# EasyEDA Pro project 库洛密nfc.eprj

# Schematic Schematic1
Board Name: Board1; Create Date: 2025-10-13; Page Name: P1; Project Name: 校园卡PCB; Schematic Name: Schematic1; Update Date: 2025-10-13; Company: 嘉立创EDA; Page Size: A4; Version: V1.0
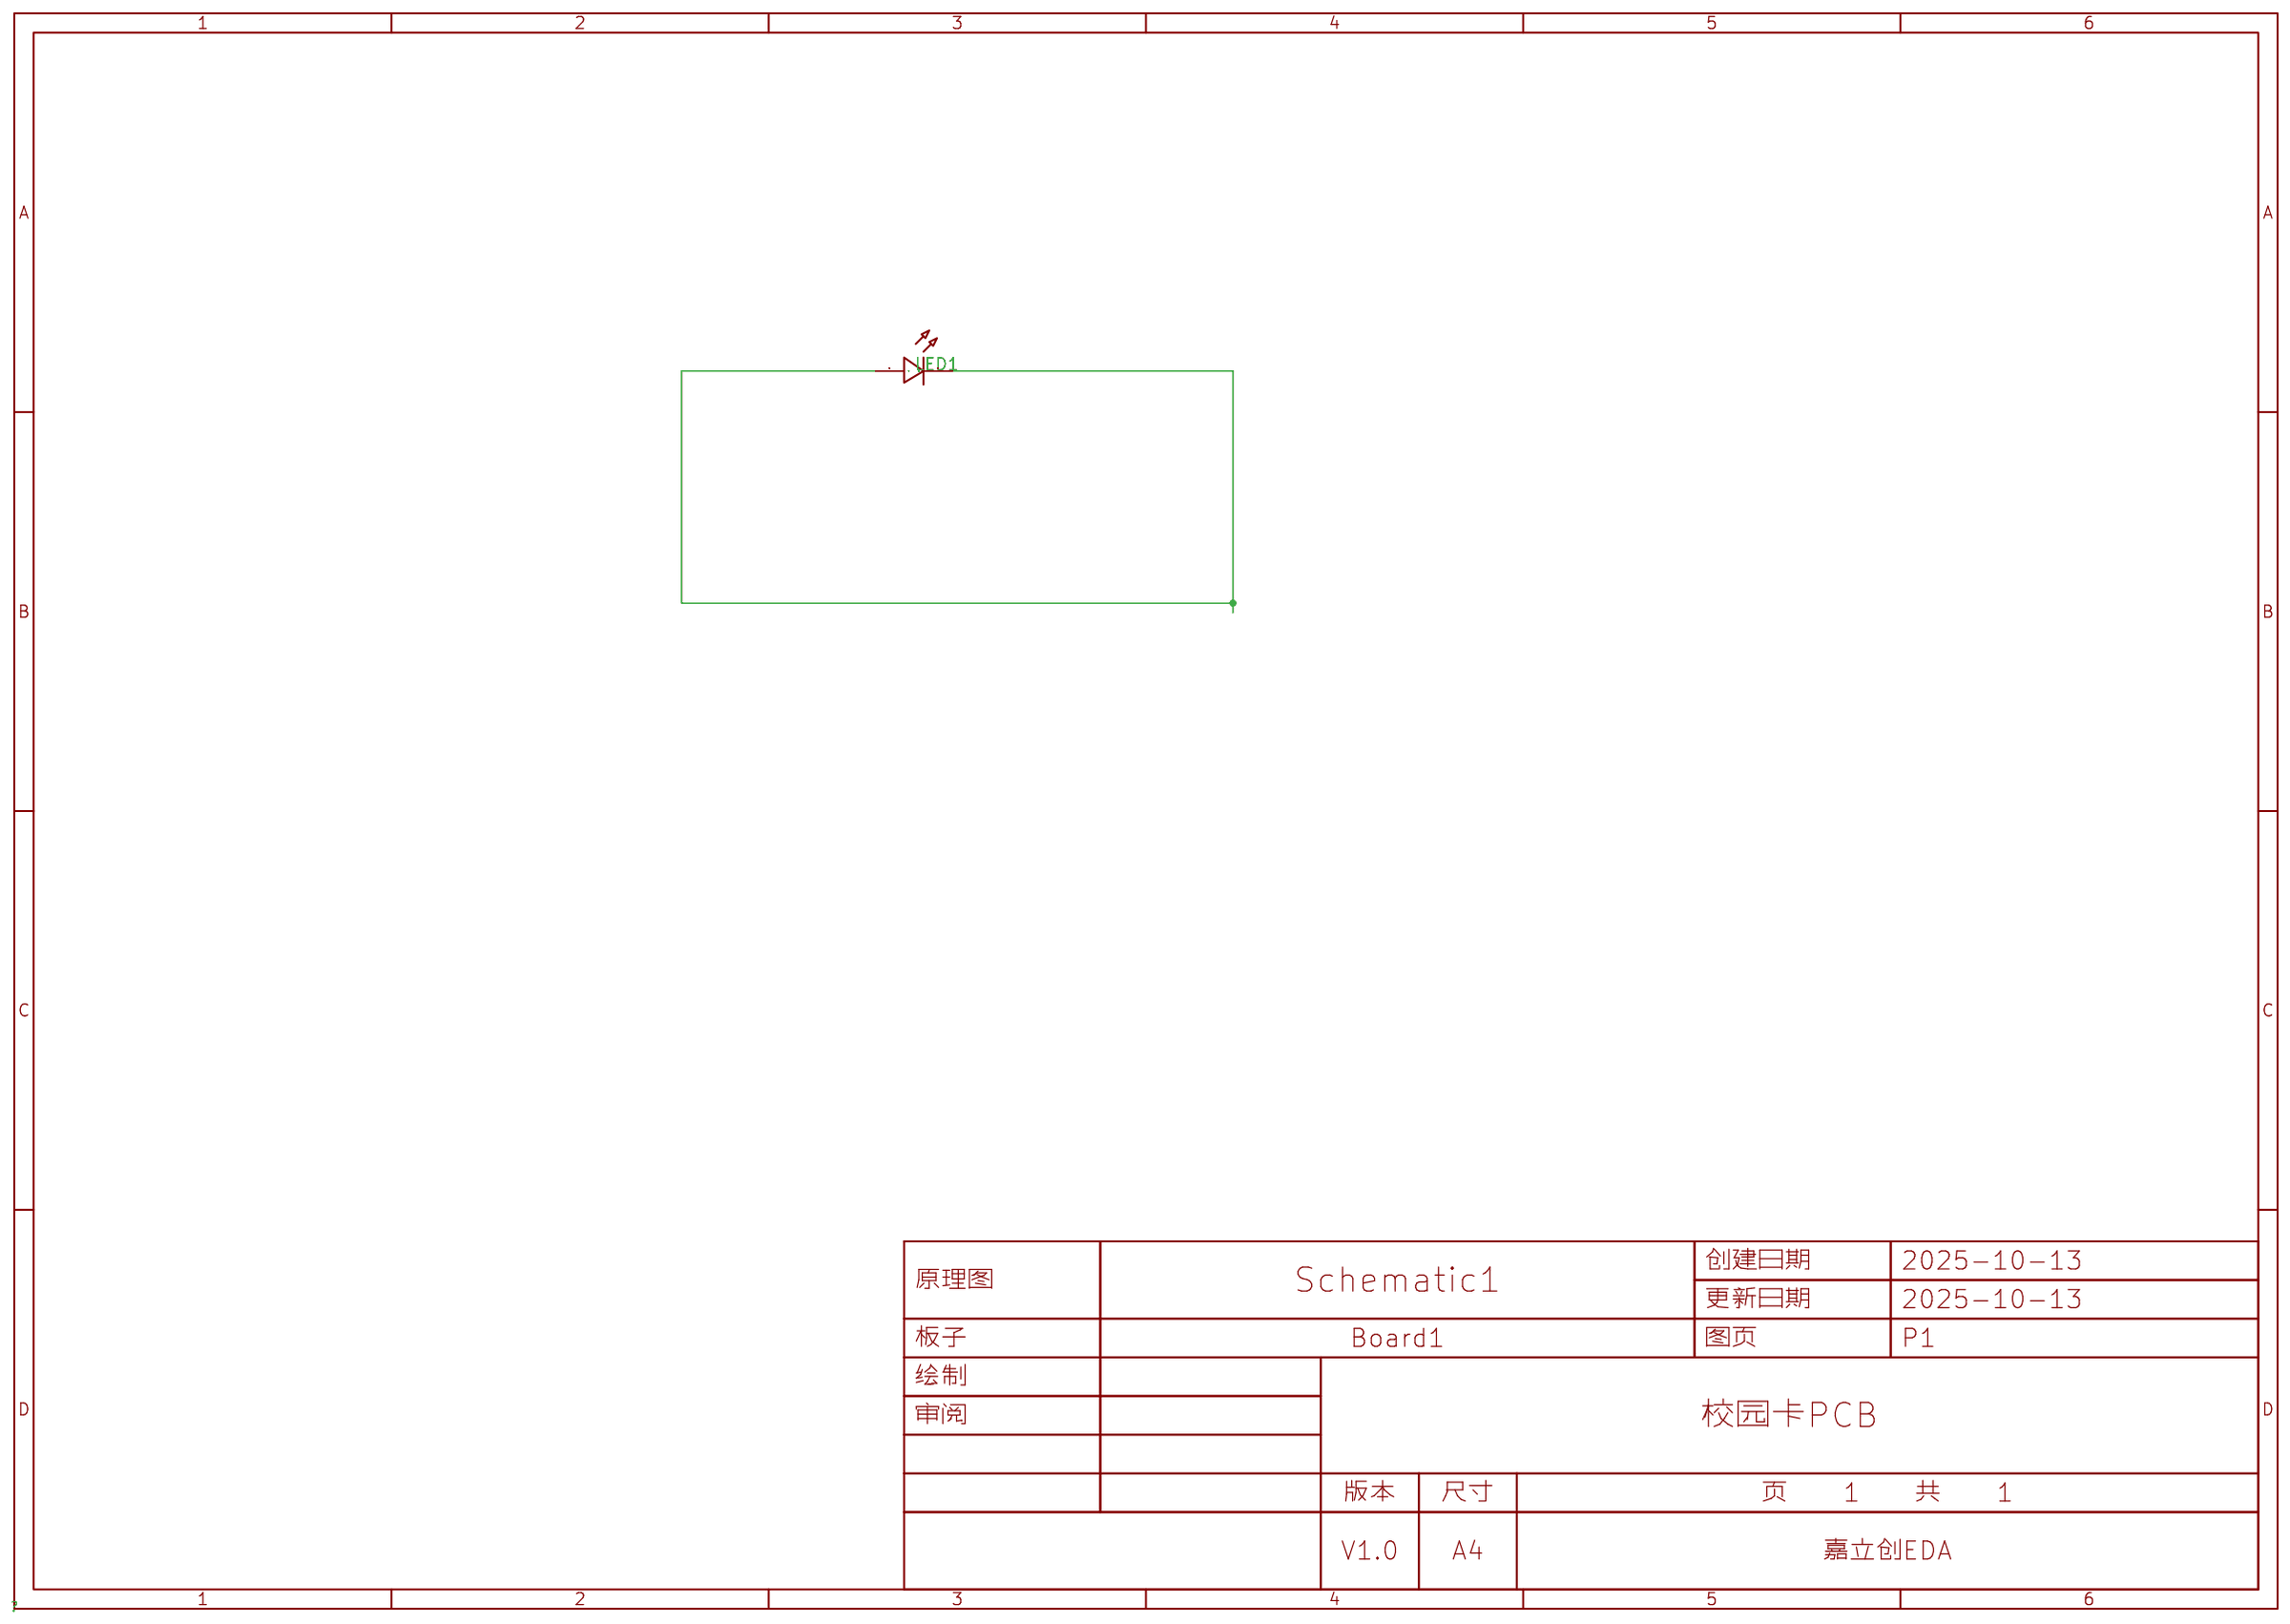
[diagram p0: schematic sheet]

## Parts
LED1  -  [LED_0805]

## Library data of the parts
LED1 = LED_0805-R: Supplier Footprint: 0805

## Nets
Net-(LED1-1): LED1.1(C) LED1.2(A)

# Board 沉金74x45
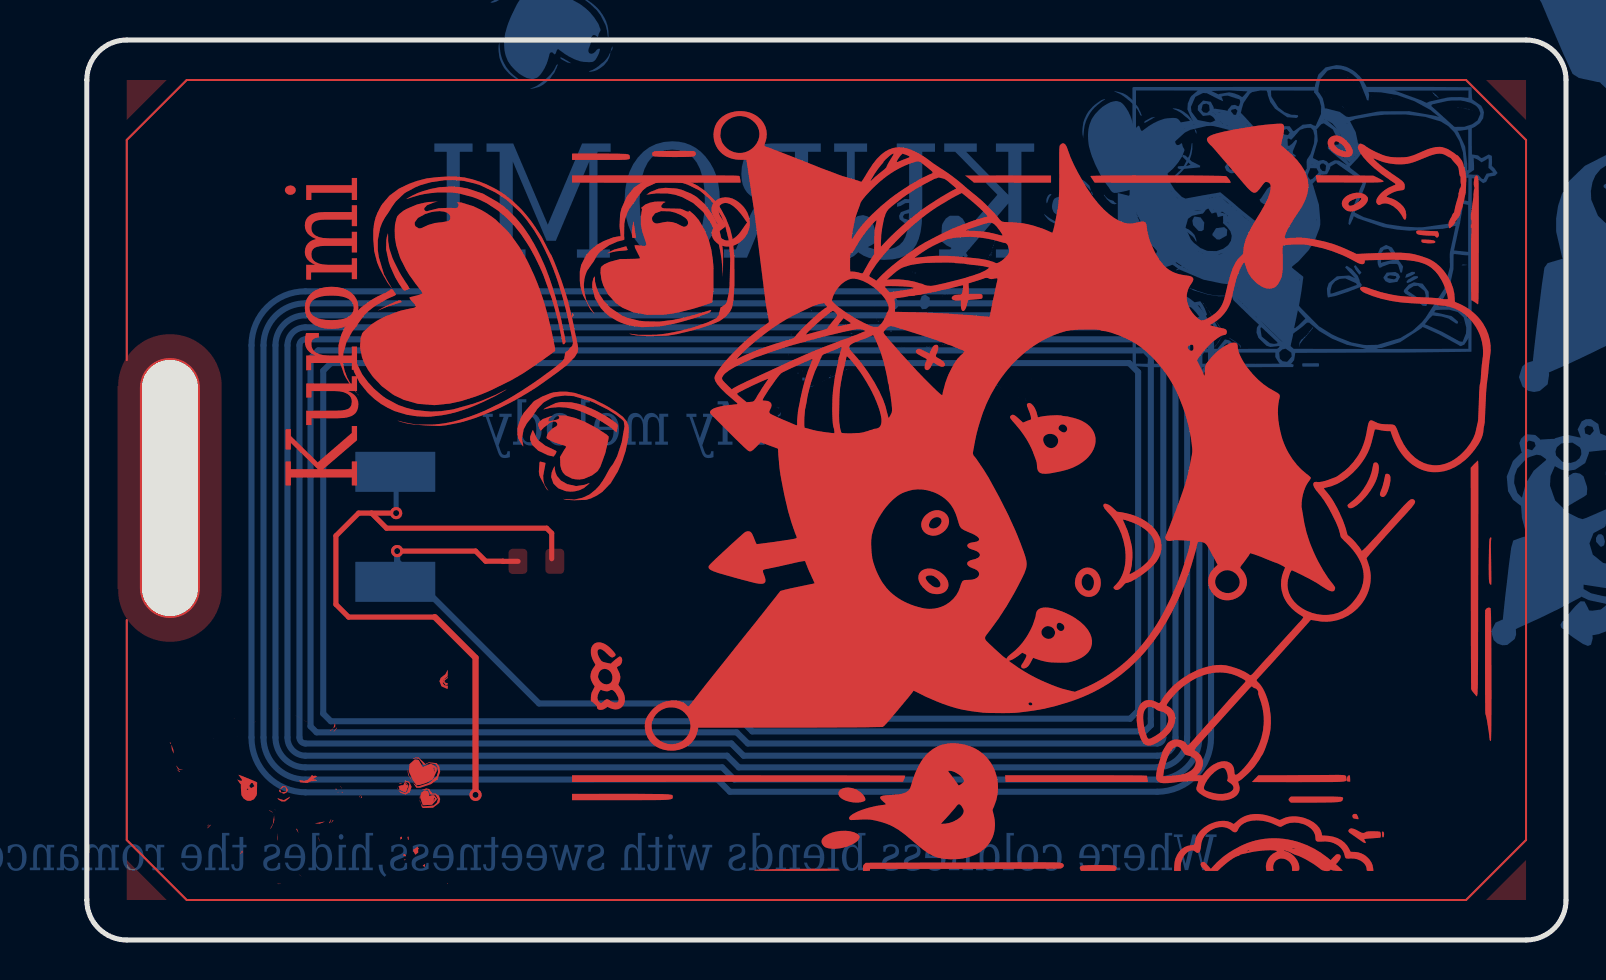
[diagram p1: board, top side]
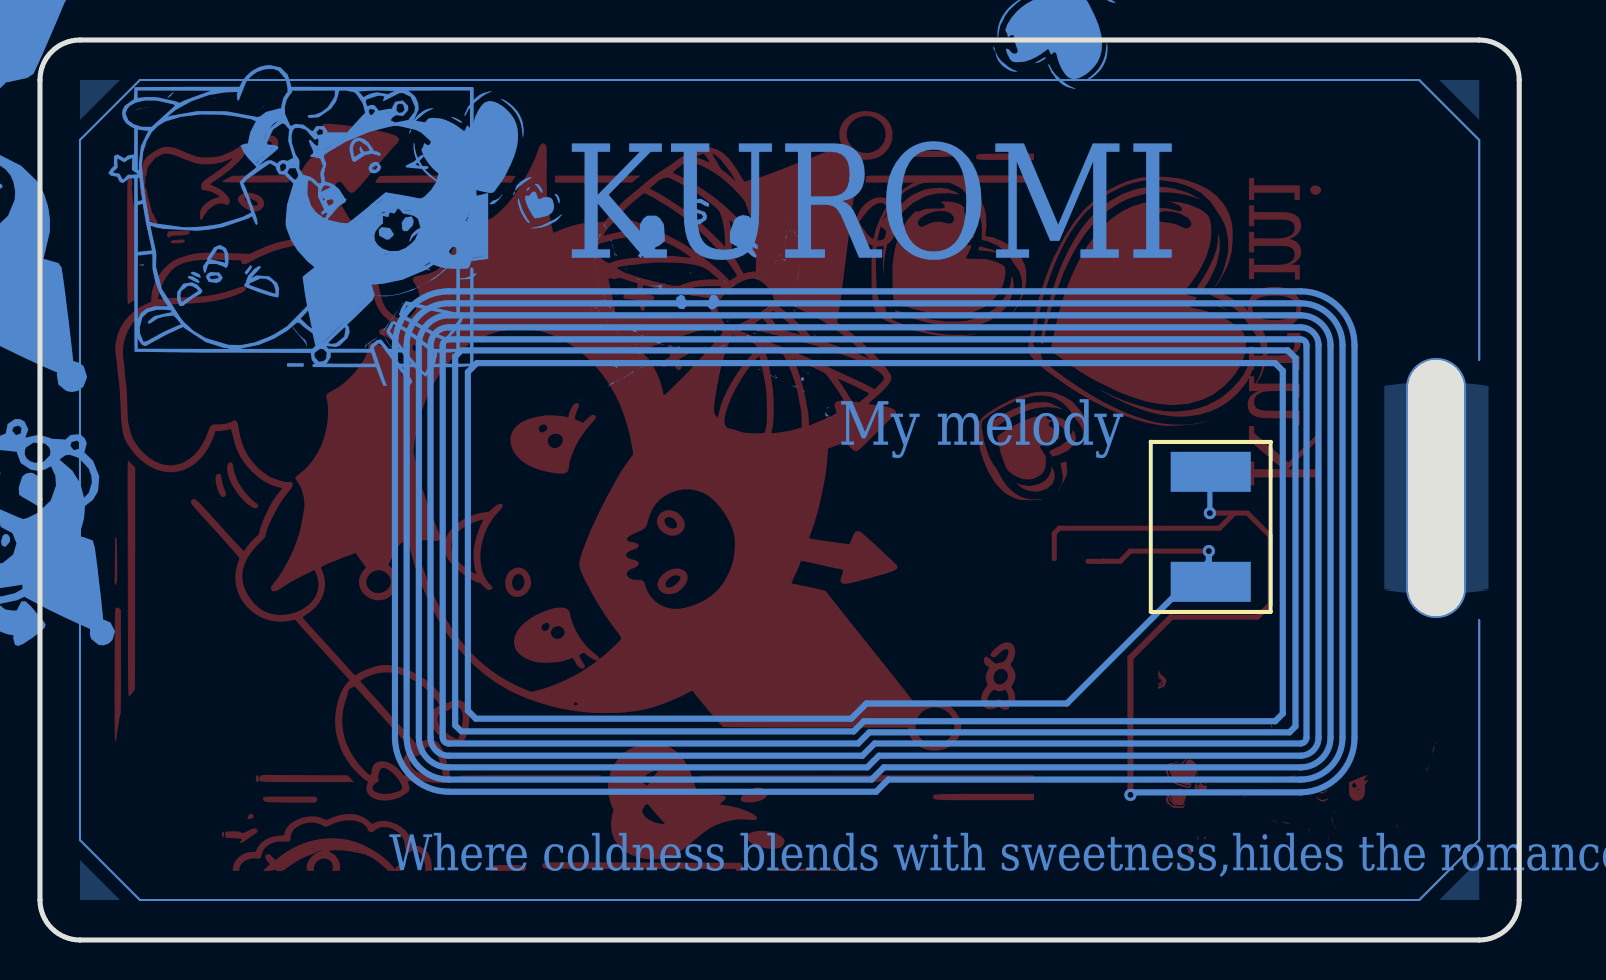
[diagram p2: board, bottom side, seen from below]

Outline 74 x 45 mm; copper layers: Top Layer, Bottom Layer. Coordinates in mm from the lower left corner of the outline.
Outline path: 0,43 0,2 arc(0.59,0.59) 2,0 72,0 arc(73.41,0.59) 74,2 74,43 arc(73.41,44.41) 72,45 2,45 arc(0.59,44.41) 0,43
Stack: Top Layer 0.035mm / Dielectric1 1.51mm FR4 er 4.5 / Bottom Layer 0.035mm

## Design rules (mm)
spacing copperThickness1oz (default): track to track 0.102, other pairs 0.152 to 0.3
spacing copperThickness2oz: track to track 0.203, other pairs 0.152 to 0.3
spacing Plane_innerPlane: track to track 0.102, other pairs 0.152 to 0.3
spacing Copper_copperRegion: track to track 0.102, other pairs 0.152 to 0.3
track width copperThickness1oz (default): min 0.127, default 0.254, max 2.54
track width copperThickness2oz: min 0.203, default 0.254, max 2.54
differential pair differentialPair (default): width min 0.127, default 0.254, max 2.54; gap min 0.152, default 0.152
via viaSize (default): diameter min 0.5, default 0.61, max 10; hole min 0.3, default 0.305, max 6.3

## Placement (name value [footprint] x y rotation side)
NOREF  -  [Pad_e4]  4.16 22.6 0 top
U7  CUID芯片1  [SW-001-2]  18.43 24.91 180 bottom

## Footprints (pads in the part's own frame, mm; a bottom-side part is the same pattern mirrored in y, then rotated)
Pad_e4
  oval 3x13 hole 2.8x12.8: 1(0,0)
SW-001-2
  rect 4x2 smd: 1(3,-1.5) 2(3,-7)

## Nets
NET1: U7.1
NET2: U7.2

Pads without a net: NOREF 1

## Via types
v1: diameter 0.61, hole 0.305, Top Layer to Bottom Layer, 3 vias

## Routing (per net, layer and track width the routed paths; a pad name or vN(x,y) marks a point on that pad's centre or on a via; arc(x,y) is an arc through that point)
NET1: length 692.3
  Top Layer w0.254: 23.26,19.07 23.26,20.34 23,20.59 14.99,20.59 14.24,21.34 ; 17.42,16.15 13.1,16.15 12.46,16.78 12.46,20.21 13.6,21.34 14.24,21.34 ; 14.24,21.34 v1(15.47,21.34)
  Top Layer w0.305: 17.42,16.15 19.45,14.11 v1(19.45,7.25)
  Bottom Layer w0.254: v1(15.47,21.34) 15.47,23.36 U7.1
  Bottom Layer w0.305: 53.55,9.83 arc(53.76,9.91) 53.85,10.13 53.85,29.73 arc(53.76,29.95) 53.55,30.03 10.94,30.03 arc(10.73,29.95) 10.64,29.73 10.64,10.13 arc(10.73,9.92) 10.94,9.83 32.25,9.83 32.86,9.22 53.55,9.22 arc(54.2,9.48) 54.46,10.13 54.46,29.73 arc(54.19,30.37) 53.55,30.63 10.94,30.63 arc(10.3,30.37) 10.04,29.73 10.04,10.13 arc(10.3,9.49) 10.94,9.22 32.03,9.22 32.61,8.63 53.55,8.63 arc(54.61,9.07) 55.05,10.13 55.05,29.73 arc(54.61,30.79) 53.55,31.23 10.94,31.23 arc(9.88,30.79) 9.44,29.73 9.44,10.13 arc(9.88,9.07) 10.94,8.63 31.79,8.63 32.4,8.02 53.55,8.02 arc(55.04,8.64) 55.66,10.13 55.66,29.73 arc(55.04,31.22) 53.55,31.83 10.94,31.83 arc(9.45,31.22) 8.84,29.73 8.84,10.13 arc(9.45,8.64) 10.94,8.02 31.56,8.02 32.17,7.41 53.55,7.41 arc(55.46,8.21) 56.24,10.13 56.24,29.73 arc(55.45,31.64) 53.55,32.43 10.94,32.43 arc(9.03,31.64) 8.24,29.73 8.24,10.13 arc(9.02,8.2) 10.94,7.38 19.32,7.38 v1(19.45,7.25) ; 53.55,9.83 33.07,9.83 32.51,10.38
NET2: length 264.7
  Top Layer w0.254: 21.57,18.93 20.82,18.93 20.81,18.94 19.96,18.94 19.45,19.45 v1(15.53,19.45)
  Bottom Layer w0.305: 32.51,10.38 11.49,10.38 11.19,10.68 11.19,29.1 11.57,29.48 52.8,29.48 ; 52.92,10.43 53.23,10.73 53.23,29.17 52.92,29.48 ; 52.8,10.43 33.29,10.43 32.78,10.94 12.21,10.94 11.83,11.32 11.83,28.46 12.21,28.84 52.15,28.84 52.59,28.4 52.59,11.47 52.19,11.06 33.42,11.06 32.66,11.83 22.62,11.83 15.53,18.92 v1(15.53,19.45)

## Copper pours and planes (outline as drawn; the poured copper is in the pictures)
(no net) on Top Layer: 70,4 72,4 72,2 70,2
(no net) on Top Layer: 1.54,30.29 6.75,30.29 6.75,14.91 1.54,14.91
(no net) on Top Layer: 2,43 4,43 4,41 2,41
(no net) on Top Layer: 70,43 72,43 72,41 70,41
(no net) on Top Layer: 2,4 4,4 4,2 2,2
(no net) on Bottom Layer: 70,4 72,4 72,2 70,2
(no net) on Bottom Layer: 1.54,27.7 6.75,27.7 6.75,17.54 1.54,17.54
(no net) on Bottom Layer: 2,43 4,43 4,41 2,41
(no net) on Bottom Layer: 2,4 4,4 4,2 2,2
(no net) on Bottom Layer: 70,43 72,43 72,41 70,41
NET1 on Top Layer: 22.94,19.56 23.88,19.56 23.88,18.31 22.94,18.31
NET2 on Top Layer: 21.1,19.56 22.04,19.56 22.04,18.3 21.1,18.3
S$139752 on Bottom Layer: 1.57,27.9 6.75,27.9 6.75,27.5 1.57,27.5
S$139752 on Bottom Layer: 1.57,17.7 6.75,17.7 6.75,17.3 1.57,17.3

Small or netless copper shapes (teardrops, artwork), in the pictures only: 180 on Top Layer, 644 on Bottom Layer

## Text on the board
Bottom Layer: KUROMI | Where coldness blends with sweetness,hides the romance of Kuromi. | My melody
Bottom Solder Mask Layer: KUROMI | Where coldness blends with sweetness,hides the romance of Kuromi. | My melody
Top Layer: Kuromi
Top Solder Mask Layer: Kuromi
